# EasyEDA Pro project kuafu01_030内部老化方案_4.eprj, board PCB4 (continued)
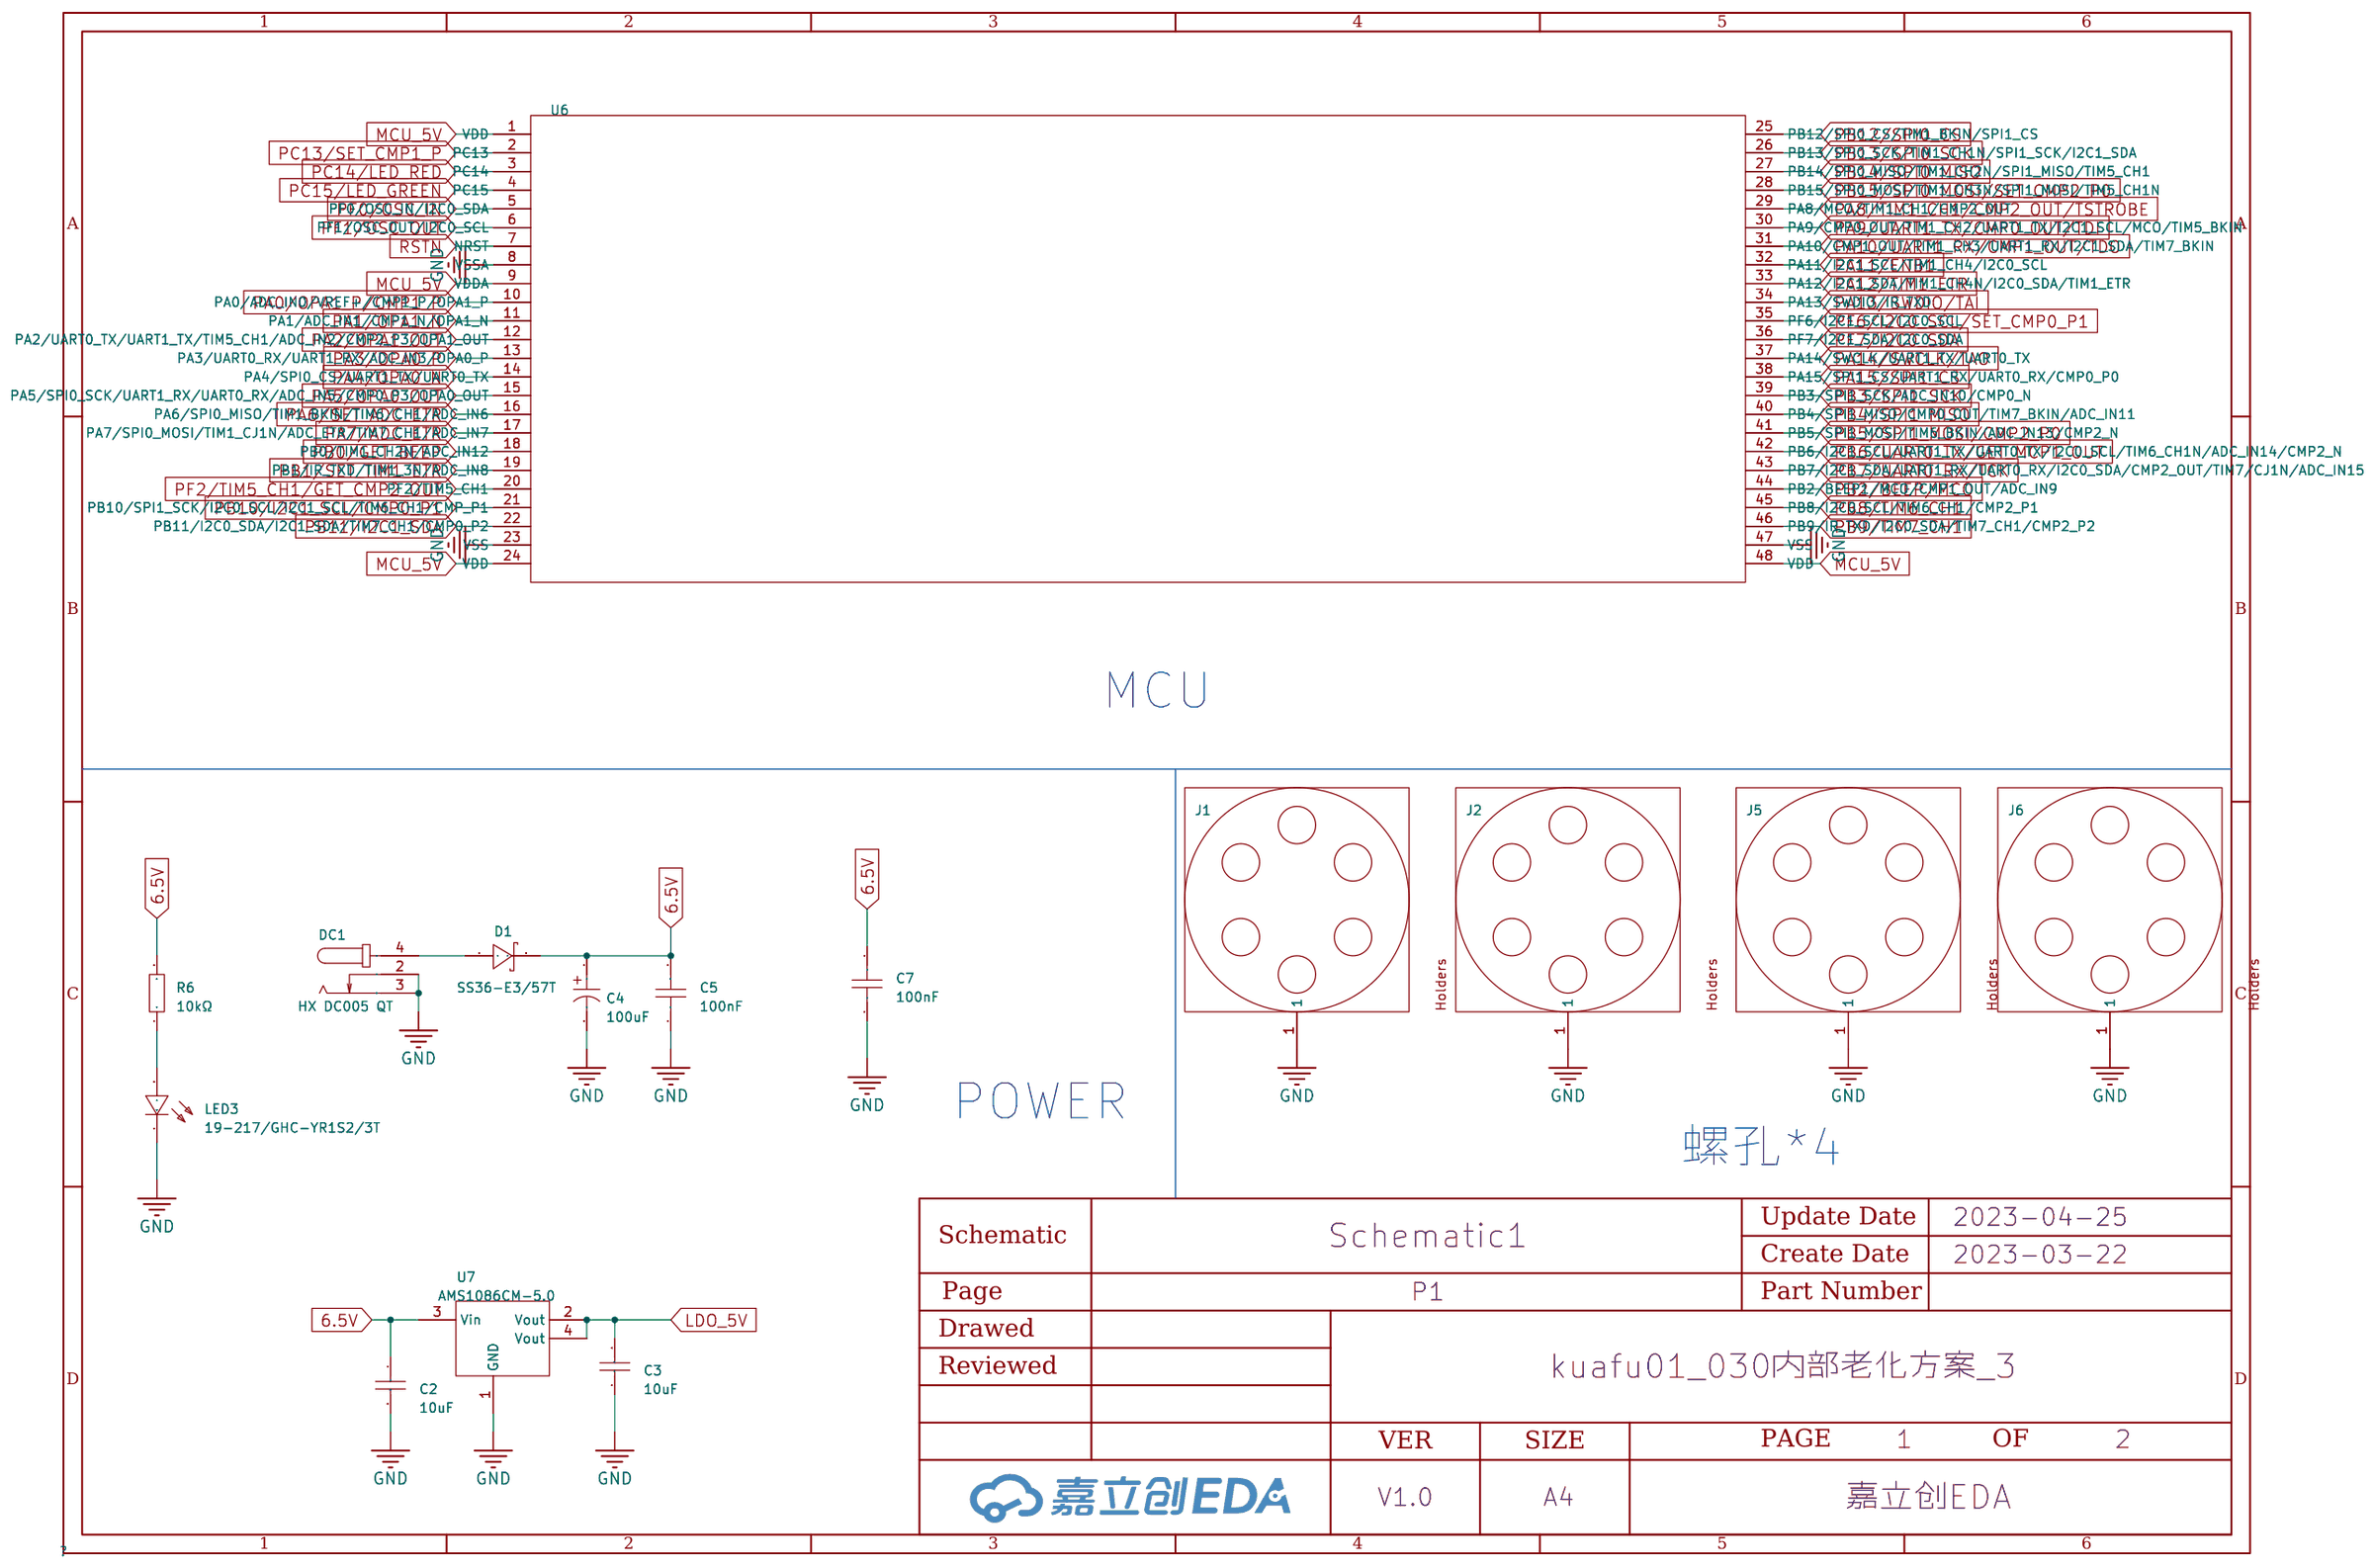
[diagram p0: P1]
## Routing (per net, layer and track width the routed paths; a pad name or vN(x,y) marks a point on that pad's centre or on a via; arc(x,y) is an arc through that point) (continued)
PB7/UART0_RX/TCK: length 1598.6
  Top Layer w0.28: U6#23.43 30.58,19.44 v1(31.47,20.33) 32.28,21.13 41.26,21.13 42.55,22.42 53.09,22.42 54.13,21.37 54.13,11.55 52.98,10.4 46.75,10.4 H4#22.2 ; U6#4.43 232.77,132.22 v1(233.66,133.11) 234.46,133.91 243.45,133.91 244.73,135.19 255.27,135.19 256.32,134.15 256.32,124.33 255.17,123.18 248.93,123.18 H4#5.2 ; U6#12.43 131.68,244.99 v1(132.56,245.88) 133.37,246.69 142.36,246.69 143.64,247.97 154.18,247.97 155.23,246.92 155.23,237.1 154.08,235.95 147.84,235.95 H4#10.2 ; U6#6.43 232.77,169.81 v1(233.66,170.7) 234.46,171.5 243.45,171.5 244.73,172.78 255.27,172.78 256.32,171.74 256.32,161.92 255.17,160.77 248.93,160.77 H4#7.2 ; U6#3.43 30.58,132.22 v1(31.47,133.11) 32.28,133.91 41.26,133.91 42.55,135.19 53.09,135.19 54.13,134.15 54.13,124.33 52.98,123.18 46.75,123.18 H4#3.2 ; U6#28.43 232.77,207.4 v1(233.66,208.29) 234.46,209.09 243.45,209.09 244.73,210.38 255.27,210.38 256.32,209.33 256.32,199.51 255.17,198.36 248.93,198.36 H4#27.2 ; 182.22,166.87 182.22,169.81 v1(183.11,170.7) 183.91,171.5 192.9,171.5 194.18,172.78 204.73,172.78 205.77,171.74 205.77,161.92 204.62,160.77 198.39,160.77 H4#11.2 ; H4#6.2 198.39,123.18 204.62,123.18 205.77,124.33 205.77,134.15 204.73,135.19 194.18,135.19 192.9,133.91 183.91,133.91 v1(183.11,133.11) 182.22,132.22 182.22,129.28 ; 81.13,91.69 81.13,94.62 v1(82.02,95.51) 82.82,96.32 91.81,96.32 93.09,97.6 103.63,97.6 104.68,96.56 104.68,86.74 103.53,85.59 97.29,85.59 H4#19.2 ; 81.13,242.06 81.13,244.99 v1(82.02,245.88) 82.82,246.69 91.81,246.69 93.09,247.97 103.63,247.97 104.68,246.92 104.68,237.1 103.53,235.95 97.29,235.95 H4#32.2 ; U6#13.43 131.68,57.03 v1(132.56,57.92) 133.37,58.73 142.36,58.73 143.64,60.01 154.18,60.01 155.23,58.96 155.23,49.14 154.08,47.99 147.84,47.99 H4#15.2 ; H4#14.2 46.75,47.99 52.98,47.99 54.13,49.14 54.13,58.96 53.09,60.01 42.55,60.01 41.26,58.73 32.28,58.73 v1(31.47,57.92) 30.58,57.03 U6#14.43 ; 182.22,91.69 182.22,94.62 v1(183.11,95.51) 183.91,96.32 192.9,96.32 194.18,97.6 204.73,97.6 205.77,96.56 205.77,86.74 204.62,85.59 198.39,85.59 H4#21.2 ; 81.13,54.1 81.13,57.03 v1(82.02,57.92) 82.82,58.73 91.81,58.73 93.09,60.01 103.63,60.01 104.68,58.96 104.68,49.14 103.53,47.99 97.29,47.99 H4#12.2 ; U6#17.43 232.77,94.62 v1(233.66,95.51) 234.46,96.32 243.45,96.32 244.73,97.6 255.27,97.6 256.32,96.56 256.32,86.74 255.17,85.59 248.93,85.59 H4#18.2 ; 81.13,166.87 81.13,169.81 v1(82.02,170.7) 82.82,171.5 91.81,171.5 93.09,172.78 103.63,172.78 104.68,171.74 104.68,161.92 103.53,160.77 97.29,160.77 H4#8.2 ; 182.22,242.06 182.22,244.99 v1(183.11,245.88) 183.91,246.69 192.9,246.69 194.18,247.97 204.73,247.97 205.77,246.92 205.77,237.1 204.62,235.95 198.39,235.95 H4#24.2 ; U6#27.43 30.58,244.99 v1(31.47,245.88) 32.28,246.69 41.26,246.69 42.55,247.97 53.09,247.97 54.13,246.92 54.13,237.1 52.98,235.95 46.75,235.95 H4#25.2 ; H4#28.2 46.75,198.36 52.98,198.36 54.13,199.51 54.13,209.33 53.09,210.38 42.55,210.38 41.26,209.09 32.28,209.09 v1(31.47,208.29) 30.58,207.4 U6#31.43 ; H4#2.2 46.75,160.77 52.98,160.77 54.13,161.92 54.13,171.74 53.09,172.78 42.55,172.78 41.26,171.5 32.28,171.5 v1(31.47,170.7) 30.58,169.81 U6#9.43 ; H4#9.2 147.84,160.77 154.08,160.77 155.23,161.92 155.23,171.74 154.18,172.78 143.64,172.78 142.36,171.5 133.37,171.5 v1(132.56,170.7) 131.68,169.81 U6#8.43 ; U6#26.43 232.77,244.99 v1(233.66,245.88) 234.46,246.69 243.45,246.69 244.73,247.97 255.27,247.97 256.32,246.92 256.32,237.1 255.17,235.95 248.93,235.95 H4#26.2 ; U6#2.43 131.68,132.22 v1(132.56,133.11) 133.37,133.91 142.36,133.91 143.64,135.19 154.18,135.19 155.23,134.15 155.23,124.33 154.08,123.18 147.84,123.18 H4#4.2 ; U6#15.43 232.77,57.03 v1(233.66,57.92) 234.46,58.73 243.45,58.73 244.73,60.01 255.27,60.01 256.32,58.96 256.32,49.14 255.17,47.99 248.93,47.99 H4#16.2 ; 81.13,129.28 81.13,132.22 v1(82.02,133.11) 82.82,133.91 91.81,133.91 93.09,135.19 103.63,135.19 104.68,134.15 104.68,124.33 103.53,123.18 97.29,123.18 H4.2 ; H4#31.2 198.39,198.36 204.62,198.36 205.77,199.51 205.77,209.33 204.73,210.38 194.18,210.38 192.9,209.09 183.91,209.09 v1(183.11,208.29) 182.22,207.4 182.22,204.47 ; H4#20.2 147.84,85.59 154.08,85.59 155.23,86.74 155.23,96.56 154.18,97.6 143.64,97.6 142.36,96.32 133.37,96.32 v1(132.56,95.51) 131.68,94.62 U6#19.43 ; U6#30.43 131.68,207.4 v1(132.56,208.29) 133.37,209.09 142.36,209.09 143.64,210.38 154.18,210.38 155.23,209.33 155.23,199.51 154.08,198.36 147.84,198.36 H4#30.2 ; H4#23.2 248.93,10.4 255.17,10.4 256.32,11.55 256.32,21.37 255.27,22.42 244.73,22.42 243.45,21.13 234.46,21.13 v1(233.66,20.33) 232.77,19.44 U6#24.43 ; U6#20.43 30.58,94.62 v1(31.47,95.51) 32.28,96.32 41.26,96.32 42.55,97.6 53.09,97.6 54.13,96.56 54.13,86.74 52.98,85.59 46.75,85.59 H4#13.2 ; 81.13,204.47 81.13,207.4 v1(82.02,208.29) 82.82,209.09 91.81,209.09 93.09,210.38 103.63,210.38 104.68,209.33 104.68,199.51 103.53,198.36 97.29,198.36 H4#29.2 ; 182.22,54.1 182.22,57.03 v1(183.11,57.92) 183.91,58.73 192.9,58.73 194.18,60.01 204.73,60.01 205.77,58.96 205.77,49.14 204.62,47.99 198.39,47.99 H4#17.2
  Bottom Layer w0.28: v1(31.47,208.29) 31.01,208.75 31.01,211.81 CN1#27.5 ; v1(183.11,57.92) 182.65,58.38 182.65,61.44 CN1#21.5 ; v1(31.47,57.92) 31.01,58.38 31.01,61.44 CN1#15.5 ; CN1#13.5 182.65,99.03 182.65,95.97 v1(183.11,95.51) ; v1(233.66,133.11) 233.2,133.56 233.2,136.63 CN1.5 ; CN1#26.5 233.2,249.4 233.2,246.34 v1(233.66,245.88) ; v1(82.02,208.29) 81.56,208.75 81.56,211.81 CN1#30.5 ; CN1#12.5 233.2,61.44 233.2,58.38 v1(233.66,57.92) ; v1(132.56,133.11) 132.11,133.56 132.11,136.63 CN1#8.5 ; v1(31.47,170.7) 31.01,171.15 31.01,174.22 CN1#3.5 ; CN1#9.5 81.56,174.22 81.56,171.15 v1(82.02,170.7) ; v1(31.47,95.51) 31.01,95.97 31.01,99.03 CN1#14.5 ; v1(183.11,208.29) 182.65,208.75 182.65,211.81 CN1#28.5 ; v1(183.11,133.11) 182.65,133.56 182.65,136.63 CN1#10.5 ; v1(31.47,133.11) 31.01,133.56 31.01,136.63 CN1#4.5 ; CN1#18.5 132.11,99.03 132.11,95.97 v1(132.56,95.51) ; CN1#31.5 132.11,211.81 132.11,208.75 v1(132.56,208.29) ; v1(233.66,95.51) 233.2,95.97 233.2,99.03 CN1#17.5 ; v1(132.56,170.7) 132.11,171.15 132.11,174.22 CN1#7.5 ; v1(233.66,170.7) 233.2,171.15 233.2,174.22 CN1#6.5 ; v1(82.02,245.88) 81.56,246.34 81.56,249.4 CN1#32.5 ; CN1#24.5 31.01,249.4 31.01,246.34 v1(31.47,245.88) ; CN1#29.5 233.2,211.81 233.2,208.75 v1(233.66,208.29) ; v1(183.11,170.7) 182.65,171.15 182.65,174.22 CN1#2.5 ; v1(82.02,57.92) 81.56,58.38 81.56,61.44 CN1#16.5 ; CN1#20.5 81.56,99.03 81.56,95.97 v1(82.02,95.51) ; CN1#25.5 182.65,249.4 182.65,246.34 v1(183.11,245.88) ; CN1#11.5 132.11,249.4 132.11,246.34 v1(132.56,245.88) ; v1(132.56,57.92) 132.11,58.38 132.11,61.44 CN1#19.5 ; v1(82.02,133.11) 81.56,133.56 81.56,136.63 CN1#5.5 ; v1(31.47,20.33) 31.01,20.79 31.01,23.85 CN1#22.5 ; CN1#23.5 233.2,23.85 233.2,20.79 v1(233.66,20.33)
PB8/TIM6_CH1: length 16
  Top Layer w0.28: U6#31.45 U6#31.46 ; U6#17.45 U6#17.46 ; U6#12.45 U6#12.46 ; 181.22,54.1 U6#18.46 ; 80.13,204.47 U6#29.46 ; 181.22,91.69 U6#21.46 ; U6#15.45 U6#15.46 ; 80.13,54.1 U6#16.46 ; U6#6.45 U6#6.46 ; U6#4.45 U6#4.46 ; U6#20.45 U6#20.46 ; U6#28.45 U6#28.46 ; U6#19.45 U6#19.46 ; U6#24.45 U6#24.46 ; 181.22,204.47 U6#32.46 ; 80.13,91.69 U6#22.46 ; U6#26.45 U6#26.46 ; 80.13,242.06 U6.46 ; U6#9.45 U6#9.46 ; U6#3.45 U6#3.46 ; 80.13,129.28 U6#5.46 ; 181.22,129.28 U6#7.46 ; U6#30.45 U6#30.46 ; U6#23.45 U6#23.46 ; 181.22,166.87 U6#10.46 ; U6#2.45 U6#2.46 ; U6#27.45 U6#27.46 ; 80.13,166.87 U6#11.46 ; 181.22,242.06 U6#25.46 ; U6#14.45 U6#14.46 ; U6#8.45 U6#8.46 ; U6#13.45 U6#13.46
PB10/I2C1_SCL/CMP0_P1: length 907.4
  Top Layer w0.28: U6#31.21 32.08,193.57 32.49,193.16 36.77,193.16 v1(37.36,193.75) ; v1(87.91,156.16) 87.32,155.57 83.04,155.57 82.63,155.98 U6#11.21 ; v1(189,43.38) 188.41,42.79 184.13,42.79 183.72,43.21 U6#18.21 ; 145.27,130.79 145.23,130.75 142.67,130.75 140.02,128.1 138.49,128.1 v1(138.47,128.13) 138.11,128.13 137.31,127.33 U6#2.35 ; v1(239.55,156.16) 238.96,155.57 234.68,155.57 234.27,155.98 U6#6.21 ; U6.35 86.76,240.11 87.56,240.9 v1(87.92,240.9) 87.95,240.88 89.47,240.88 92.12,243.52 94.69,243.52 94.73,243.56 ; U6#30.21 133.17,193.57 133.59,193.16 137.87,193.16 v1(138.46,193.75) ; U6#32.35 187.86,202.52 188.65,203.31 v1(189.01,203.31) 189.04,203.28 190.56,203.28 193.21,205.93 195.78,205.93 195.82,205.97 ; U6#13.35 137.31,52.15 138.11,52.94 v1(138.47,52.94) 138.49,52.92 140.02,52.92 142.67,55.56 145.23,55.56 145.27,55.6 ; 94.73,55.6 94.69,55.56 92.12,55.56 89.47,52.92 87.95,52.92 v1(87.92,52.94) 87.56,52.94 86.76,52.15 U6#16.35 ; U6#27.21 32.08,231.17 32.49,230.75 36.77,230.75 v1(37.36,231.34) ; U6#12.35 137.31,240.11 138.11,240.9 v1(138.47,240.9) 138.49,240.88 140.02,240.88 142.67,243.52 145.23,243.52 145.27,243.56 ; v1(138.46,118.57) 137.87,117.98 133.59,117.98 133.17,118.39 U6#2.21 ; U6#28.21 234.27,193.57 234.68,193.16 238.96,193.16 v1(239.55,193.75) ; U6#4.35 238.4,127.33 239.2,128.13 v1(239.56,128.13) 239.59,128.1 241.11,128.1 243.76,130.75 246.33,130.75 246.36,130.79 ; U6#23.35 36.22,14.56 37.01,15.35 v1(37.37,15.35) 37.4,15.32 38.93,15.32 41.58,17.97 44.14,17.97 44.18,18.01 ; U6#30.35 137.31,202.52 138.11,203.31 v1(138.47,203.31) 138.49,203.28 140.02,203.28 142.67,205.93 145.23,205.93 145.27,205.97 ; 44.18,243.56 44.14,243.52 41.58,243.52 38.93,240.88 37.4,240.88 v1(37.37,240.9) 37.01,240.9 36.22,240.11 U6#27.35 ; 195.82,243.56 195.78,243.52 193.21,243.52 190.56,240.88 189.04,240.88 v1(189.01,240.9) 188.65,240.9 187.86,240.11 U6#25.35 ; U6#19.35 137.31,89.74 138.11,90.54 v1(138.47,90.54) 138.49,90.51 140.02,90.51 142.67,93.16 145.23,93.16 145.27,93.2 ; v1(87.91,43.38) 87.32,42.79 83.04,42.79 82.63,43.21 U6#16.21 ; 44.18,205.97 44.14,205.93 41.58,205.93 38.93,203.28 37.4,203.28 v1(37.37,203.31) 37.01,203.31 36.22,202.52 U6#31.35 ; v1(138.46,80.98) 137.87,80.39 133.59,80.39 133.17,80.8 U6#19.21 ; U6#4.21 234.27,118.39 234.68,117.98 238.96,117.98 v1(239.55,118.57) ; U6#29.21 82.63,193.57 83.04,193.16 87.32,193.16 v1(87.91,193.75) ; U6#6.35 238.4,164.92 239.2,165.72 v1(239.56,165.72) 239.59,165.69 241.11,165.69 243.76,168.34 246.33,168.34 246.36,168.38 ; U6#17.35 238.4,89.74 239.2,90.54 v1(239.56,90.54) 239.59,90.51 241.11,90.51 243.76,93.16 246.33,93.16 246.36,93.2 ; 94.73,130.79 94.69,130.75 92.12,130.75 89.47,128.1 87.95,128.1 v1(87.92,128.13) 87.56,128.13 86.76,127.33 U6#5.35 ; v1(189,118.57) 188.41,117.98 184.13,117.98 183.72,118.39 U6#7.21 ; U6#14.21 32.08,43.21 32.49,42.79 36.77,42.79 v1(37.36,43.38) ; U6#13.21 133.17,43.21 133.59,42.79 137.87,42.79 v1(138.46,43.38) ; U6#21.21 183.72,80.8 184.13,80.39 188.41,80.39 v1(189,80.98) ; U6#26.35 238.4,240.11 239.2,240.9 v1(239.56,240.9) 239.59,240.88 241.11,240.88 243.76,243.52 246.33,243.52 246.36,243.56 ; U6#20.35 36.22,89.74 37.01,90.54 v1(37.37,90.54) 37.4,90.51 38.93,90.51 41.58,93.16 44.14,93.16 44.18,93.2 ; U6#3.35 36.22,127.33 37.01,128.13 v1(37.37,128.13) 37.4,128.1 38.93,128.1 41.58,130.75 44.14,130.75 44.18,130.79 ; U6#22.21 82.63,80.8 83.04,80.39 87.32,80.39 v1(87.91,80.98) ; v1(37.36,156.16) 36.77,155.57 32.49,155.57 32.08,155.98 U6#9.21 ; U6#10.21 183.72,155.98 184.13,155.57 188.41,155.57 v1(189,156.16) ; U6#18.35 187.86,52.15 188.65,52.94 v1(189.01,52.94) 189.04,52.92 190.56,52.92 193.21,55.56 195.78,55.56 195.82,55.6 ; 246.36,55.6 246.33,55.56 243.76,55.56 241.11,52.92 239.59,52.92 v1(239.56,52.94) 239.2,52.94 238.4,52.15 U6#15.35 ; U6#9.35 36.22,164.92 37.01,165.72 v1(37.37,165.72) 37.4,165.69 38.93,165.69 41.58,168.34 44.14,168.34 44.18,168.38 ; U6#23.21 32.08,5.61 32.49,5.2 36.77,5.2 v1(37.36,5.79) ; v1(138.46,231.34) 137.87,230.75 133.59,230.75 133.17,231.17 U6#12.21 ; v1(239.55,231.34) 238.96,230.75 234.68,230.75 234.27,231.17 U6#26.21 ; U6#20.21 32.08,80.8 32.49,80.39 36.77,80.39 v1(37.36,80.98) ; U6#29.35 86.76,202.52 87.56,203.31 v1(87.92,203.31) 87.95,203.28 89.47,203.28 92.12,205.93 94.69,205.93 94.73,205.97 ; 145.27,168.38 145.23,168.34 142.67,168.34 140.02,165.69 138.49,165.69 v1(138.47,165.72) 138.11,165.72 137.31,164.92 U6#8.35 ; 195.82,130.79 195.78,130.75 193.21,130.75 190.56,128.1 189.04,128.1 v1(189.01,128.13) 188.65,128.13 187.86,127.33 U6#7.35 ; U6#21.35 187.86,89.74 188.65,90.54 v1(189.01,90.54) 189.04,90.51 190.56,90.51 193.21,93.16 195.78,93.16 195.82,93.2 ; 246.36,18.01 246.33,17.97 243.76,17.97 241.11,15.32 239.59,15.32 v1(239.56,15.35) 239.2,15.35 238.4,14.56 U6#24.35 ; U6#24.21 234.27,5.61 234.68,5.2 238.96,5.2 v1(239.55,5.79) ; U6.21 82.63,231.17 83.04,230.75 87.32,230.75 v1(87.91,231.34) ; U6#22.35 86.76,89.74 87.56,90.54 v1(87.92,90.54) 87.95,90.51 89.47,90.51 92.12,93.16 94.69,93.16 94.73,93.2 ; U6#14.35 36.22,52.15 37.01,52.94 v1(37.37,52.94) 37.4,52.92 38.93,52.92 41.58,55.56 44.14,55.56 44.18,55.6 ; U6#3.21 32.08,118.39 32.49,117.98 36.77,117.98 v1(37.36,118.57) ; 246.36,205.97 246.33,205.93 243.76,205.93 241.11,203.28 239.59,203.28 v1(239.56,203.31) 239.2,203.31 238.4,202.52 U6#28.35 ; v1(138.46,156.16) 137.87,155.57 133.59,155.57 133.17,155.98 U6#8.21 ; v1(239.55,80.98) 238.96,80.39 234.68,80.39 234.27,80.8 U6#17.21 ; U6#32.21 183.72,193.57 184.13,193.16 188.41,193.16 v1(189,193.75) ; U6#25.21 183.72,231.17 184.13,230.75 188.41,230.75 v1(189,231.34) ; v1(239.55,43.38) 238.96,42.79 234.68,42.79 234.27,43.21 U6#15.21 ; U6#5.21 82.63,118.39 83.04,117.98 87.32,117.98 v1(87.91,118.57) ; 94.73,168.38 94.69,168.34 92.12,168.34 89.47,165.69 87.95,165.69 v1(87.92,165.72) 87.56,165.72 86.76,164.92 U6#11.35 ; 195.82,168.38 195.78,168.34 193.21,168.34 190.56,165.69 189.04,165.69 v1(189.01,165.72) 188.65,165.72 187.86,164.92 U6#10.35
  Bottom Layer w0.28: v1(37.37,165.72) 37.36,165.71 v1(37.36,156.16) ; v1(87.92,128.13) 87.91,128.12 v1(87.91,118.57) ; v1(138.47,240.9) 138.46,240.89 v1(138.46,231.34) ; v1(239.56,203.31) 239.55,203.3 v1(239.55,193.75) ; v1(239.55,5.79) 239.55,15.34 v1(239.56,15.35) ; v1(37.37,52.94) 37.36,52.93 v1(37.36,43.38) ; v1(37.36,118.57) 37.36,128.12 v1(37.37,128.13) ; v1(239.55,231.34) 239.55,240.89 v1(239.56,240.9) ; v1(189.01,52.94) 189,52.93 v1(189,43.38) ; v1(138.47,165.72) 138.46,165.71 v1(138.46,156.16) ; v1(37.36,231.34) 37.36,240.89 v1(37.37,240.9) ; v1(189.01,128.13) 189,128.12 v1(189,118.57) ; v1(37.37,203.31) 37.36,203.3 v1(37.36,193.75) ; v1(189,156.16) 189,165.71 v1(189.01,165.72) ; v1(239.55,156.16) 239.55,165.71 v1(239.56,165.72) ; v1(138.47,90.54) 138.46,90.53 v1(138.46,80.98) ; v1(138.46,118.57) 138.46,128.12 v1(138.47,128.13) ; v1(138.46,193.75) 138.46,203.3 v1(138.47,203.31) ; v1(239.56,90.54) 239.55,90.53 v1(239.55,80.98) ; v1(37.36,5.79) 37.36,15.34 v1(37.37,15.35) ; v1(87.92,90.54) 87.91,90.53 v1(87.91,80.98) ; v1(189,193.75) 189,203.3 v1(189.01,203.31) ; v1(87.92,165.72) 87.91,165.71 v1(87.91,156.16) ; v1(37.37,90.54) 37.36,90.53 v1(37.36,80.98) ; v1(239.56,52.94) 239.55,52.93 v1(239.55,43.38) ; v1(87.91,43.38) 87.91,52.93 v1(87.92,52.94) ; v1(189.01,240.9) 189,240.89 v1(189,231.34) ; v1(87.92,240.9) 87.91,240.89 v1(87.91,231.34) ; v1(189.01,90.54) 189,90.53 v1(189,80.98) ; v1(239.56,128.13) 239.55,128.12 v1(239.55,118.57) ; v1(87.91,193.75) 87.91,203.3 v1(87.92,203.31) ; v1(138.47,52.94) 138.46,52.93 v1(138.46,43.38)
PB11/I2C1_SDA: length 885.6
  Top Layer w0.28: v1(188.31,43.78) 187.82,43.29 184.51,43.29 184.22,43.59 184.22,45.7 ; v1(188.31,231.74) 187.82,231.25 184.51,231.25 184.22,231.55 184.22,233.66 ; 195.82,58.03 194.74,58.03 190.26,53.55 v1(188.31,53.55) 187.41,52.65 U6#18.36 ; U6#29.36 86.31,203.02 v1(87.22,203.92) 89.17,203.92 93.64,208.4 94.73,208.4 ; v1(87.22,118.97) 86.73,118.48 83.42,118.48 83.13,118.77 83.13,120.88 ; v1(87.22,43.78) 86.73,43.29 83.42,43.29 83.13,43.59 83.13,45.7 ; U6#31.36 35.77,203.02 v1(36.67,203.92) 38.62,203.92 43.1,208.4 44.18,208.4 ; 145.27,208.4 144.19,208.4 139.71,203.92 v1(137.77,203.92) 136.86,203.02 U6#30.36 ; U6#32.36 187.41,203.02 v1(188.31,203.92) 190.26,203.92 194.74,208.4 195.82,208.4 ; v1(137.77,194.15) 137.28,193.66 133.97,193.66 133.68,193.95 U6#30.22 ; U6#9.36 35.77,165.42 v1(36.67,166.33) 38.62,166.33 43.1,170.81 44.18,170.81 ; U6#3.22 32.58,118.77 32.87,118.48 36.18,118.48 v1(36.67,118.97) ; v1(36.67,6.19) 36.18,5.7 32.87,5.7 32.58,5.99 U6#23.22 ; U6#27.36 35.77,240.61 v1(36.67,241.51) 38.62,241.51 43.1,245.99 44.18,245.99 ; v1(238.86,6.19) 238.37,5.7 235.06,5.7 234.77,5.99 U6#24.22 ; U6#4.22 234.77,118.77 235.06,118.48 238.37,118.48 v1(238.86,118.97) ; U6#14.36 35.77,52.65 v1(36.67,53.55) 38.62,53.55 43.1,58.03 44.18,58.03 ; 94.73,95.62 93.64,95.62 89.17,91.15 v1(87.22,91.15) 86.31,90.24 U6#22.36 ; U6#5.36 86.31,127.83 v1(87.22,128.74) 89.17,128.74 93.64,133.21 94.73,133.21 ; 44.18,133.21 43.1,133.21 38.62,128.74 v1(36.67,128.74) 35.77,127.83 U6#3.36 ; U6#13.36 136.86,52.65 v1(137.77,53.55) 139.71,53.55 144.19,58.03 145.27,58.03 ; U6#17.22 234.77,81.18 235.06,80.89 238.37,80.89 v1(238.86,81.38) ; 195.82,170.81 194.74,170.81 190.26,166.33 v1(188.31,166.33) 187.41,165.42 U6#10.36 ; v1(188.31,81.38) 187.82,80.89 184.51,80.89 184.22,81.18 184.22,83.29 ; 184.22,120.88 184.22,118.77 184.51,118.48 187.82,118.48 v1(188.31,118.97) ; 145.27,245.99 144.19,245.99 139.71,241.51 v1(137.77,241.51) 136.86,240.61 U6#12.36 ; U6#25.36 187.41,240.61 v1(188.31,241.51) 190.26,241.51 194.74,245.99 195.82,245.99 ; U6#15.22 234.77,43.59 235.06,43.29 238.37,43.29 v1(238.86,43.78) ; U6#26.22 234.77,231.55 235.06,231.25 238.37,231.25 v1(238.86,231.74) ; 246.36,170.81 245.28,170.81 240.81,166.33 v1(238.86,166.33) 237.95,165.42 U6#6.36 ; U6#8.22 133.68,156.36 133.97,156.07 137.28,156.07 v1(137.77,156.56) ; v1(137.77,118.97) 137.28,118.48 133.97,118.48 133.68,118.77 U6#2.22 ; 94.73,245.99 93.64,245.99 89.17,241.51 v1(87.22,241.51) 86.31,240.61 U6.36 ; 145.27,133.21 144.19,133.21 139.71,128.74 v1(137.77,128.74) 136.86,127.83 U6#2.36 ; v1(36.67,43.78) 36.18,43.29 32.87,43.29 32.58,43.59 U6#14.22 ; U6#11.36 86.31,165.42 v1(87.22,166.33) 89.17,166.33 93.64,170.81 94.73,170.81 ; 83.13,83.29 83.13,81.18 83.42,80.89 86.73,80.89 v1(87.22,81.38) ; U6#12.22 133.68,231.55 133.97,231.25 137.28,231.25 v1(137.77,231.74) ; U6#16.36 86.31,52.65 v1(87.22,53.55) 89.17,53.55 93.64,58.03 94.73,58.03 ; 246.36,58.03 245.28,58.03 240.81,53.55 v1(238.86,53.55) 237.95,52.65 U6#15.36 ; v1(137.77,81.38) 137.28,80.89 133.97,80.89 133.68,81.18 U6#19.22 ; 195.82,95.62 194.74,95.62 190.26,91.15 v1(188.31,91.15) 187.41,90.24 U6#21.36 ; v1(87.22,194.15) 86.73,193.66 83.42,193.66 83.13,193.95 83.13,196.07 ; U6#8.36 136.86,165.42 v1(137.77,166.33) 139.71,166.33 144.19,170.81 145.27,170.81 ; U6#9.22 32.58,156.36 32.87,156.07 36.18,156.07 v1(36.67,156.56) ; U6#27.22 32.58,231.55 32.87,231.25 36.18,231.25 v1(36.67,231.74) ; 246.36,95.62 245.28,95.62 240.81,91.15 v1(238.86,91.15) 237.95,90.24 U6#17.36 ; v1(188.31,156.56) 187.82,156.07 184.51,156.07 184.22,156.36 184.22,158.47 ; v1(238.86,194.15) 238.37,193.66 235.06,193.66 234.77,193.95 U6#28.22 ; 44.18,95.62 43.1,95.62 38.62,91.15 v1(36.67,91.15) 35.77,90.24 U6#20.36 ; 184.22,196.07 184.22,193.95 184.51,193.66 187.82,193.66 v1(188.31,194.15) ; U6#20.22 32.58,81.18 32.87,80.89 36.18,80.89 v1(36.67,81.38) ; U6#24.36 237.95,15.06 v1(238.86,15.96) 240.81,15.96 245.28,20.44 246.36,20.44 ; U6#13.22 133.68,43.59 133.97,43.29 137.28,43.29 v1(137.77,43.78) ; U6#19.36 136.86,90.24 v1(137.77,91.15) 139.71,91.15 144.19,95.62 145.27,95.62 ; 83.13,233.66 83.13,231.55 83.42,231.25 86.73,231.25 v1(87.22,231.74) ; 44.18,20.44 43.1,20.44 38.62,15.96 v1(36.67,15.96) 35.77,15.06 U6#23.36 ; 246.36,133.21 245.28,133.21 240.81,128.74 v1(238.86,128.74) 237.95,127.83 U6#4.36 ; U6#31.22 32.58,193.95 32.87,193.66 36.18,193.66 v1(36.67,194.15) ; 246.36,208.4 245.28,208.4 240.81,203.92 v1(238.86,203.92) 237.95,203.02 U6#28.36 ; 83.13,158.47 83.13,156.36 83.42,156.07 86.73,156.07 v1(87.22,156.56) ; v1(238.86,156.56) 238.37,156.07 235.06,156.07 234.77,156.36 U6#6.22 ; 195.82,133.21 194.74,133.21 190.26,128.74 v1(188.31,128.74) 187.41,127.83 U6#7.36 ; U6#26.36 237.95,240.61 v1(238.86,241.51) 240.81,241.51 245.28,245.99 246.36,245.99
  Bottom Layer w0.28: v1(238.86,156.56) v1(238.86,166.33) ; v1(36.67,118.97) v1(36.67,128.74) ; v1(36.67,6.19) v1(36.67,15.96) ; v1(137.77,156.56) v1(137.77,166.33) ; v1(137.77,231.74) v1(137.77,241.51) ; v1(238.86,194.15) v1(238.86,203.92) ; v1(87.22,81.38) v1(87.22,91.15) ; v1(188.31,156.56) v1(188.31,166.33) ; v1(238.86,118.97) v1(238.86,128.74) ; v1(36.67,231.74) v1(36.67,241.51) ; v1(36.67,81.38) v1(36.67,91.15) ; v1(36.67,156.56) v1(36.67,166.33) ; v1(87.22,156.56) v1(87.22,166.33) ; v1(87.22,43.78) v1(87.22,53.55) ; v1(137.77,43.78) v1(137.77,53.55) ; v1(87.22,231.74) v1(87.22,241.51) ; v1(36.67,43.78) v1(36.67,53.55) ; v1(238.86,43.78) v1(238.86,53.55) ; v1(188.31,81.38) v1(188.31,91.15) ; v1(188.31,194.15) v1(188.31,203.92) ; v1(87.22,194.15) v1(87.22,203.92) ; v1(137.77,81.38) v1(137.77,91.15) ; v1(188.31,231.74) v1(188.31,241.51) ; v1(238.86,6.19) v1(238.86,15.96) ; v1(238.86,231.74) v1(238.86,241.51) ; v1(188.31,118.97) v1(188.31,128.74) ; v1(188.31,43.78) v1(188.31,53.55) ; v1(137.77,194.15) v1(137.77,203.92) ; v1(87.22,118.97) v1(87.22,128.74) ; v1(238.86,81.38) v1(238.86,91.15) ; v1(36.67,194.15) v1(36.67,203.92) ; v1(137.77,118.97) v1(137.77,128.74)
PB13/SPI0_SCK: length 724.6
  Top Layer w0.28: U6#5.26 86.43,122.83 86.81,122.45 90.05,122.45 v1(90.05,122.45) ; v1(39.5,18.95) 33.66,18.95 32.59,17.88 32.59,16.52 U6#23.39 ; v1(191.14,84.86) 191.14,84.86 187.9,84.86 187.52,85.24 U6#21.26 ; v1(241.69,94.14) 235.85,94.14 234.78,93.07 234.78,91.7 U6#17.39 ; v1(241.69,9.67) 241.69,9.67 238.45,9.67 238.06,10.06 U6#24.26 ; v1(90.05,160.04) 90.05,160.04 86.81,160.04 86.43,160.42 U6#11.26 ; U6#6.39 234.78,166.89 234.78,168.25 235.85,169.32 v1(241.69,169.32) ; 184.22,54.1 184.23,54.11 184.23,55.47 185.3,56.54 v1(191.14,56.54) ; U6#12.26 136.97,235.61 137.35,235.23 140.59,235.23 v1(140.6,235.22) ; v1(39.5,94.14) 33.66,94.14 32.59,93.07 32.59,91.7 U6#20.39 ; U6#26.26 238.06,235.61 238.45,235.23 241.69,235.23 v1(241.69,235.22) ; v1(140.6,84.86) 140.59,84.86 137.35,84.86 136.97,85.24 U6#19.26 ; v1(140.6,160.04) 140.59,160.04 137.35,160.04 136.97,160.42 U6#8.26 ; v1(191.14,169.32) 185.3,169.32 184.23,168.25 184.23,166.89 184.22,166.87 ; v1(191.14,131.73) 185.3,131.73 184.23,130.66 184.23,129.29 184.22,129.28 ; v1(241.69,244.5) 235.85,244.5 234.78,243.43 234.78,242.07 U6#26.39 ; v1(140.6,197.63) 140.59,197.63 137.35,197.63 136.97,198.02 U6#30.26 ; v1(191.14,160.04) 191.14,160.04 187.9,160.04 187.52,160.42 U6#10.26 ; v1(90.05,131.73) 84.21,131.73 83.14,130.66 83.14,129.29 83.13,129.28 ; U6#20.26 35.88,85.24 36.26,84.86 39.5,84.86 v1(39.5,84.86) ; v1(90.05,206.91) 84.21,206.91 83.14,205.84 83.14,204.48 83.13,204.47 ; 184.22,242.06 184.23,242.07 184.23,243.43 185.3,244.5 v1(191.14,244.5) ; U6#4.39 234.78,129.29 234.78,130.66 235.85,131.73 v1(241.69,131.73) ; v1(191.14,235.22) 191.14,235.23 187.9,235.23 187.52,235.61 U6#25.26 ; U6#18.26 187.52,47.65 187.9,47.27 191.14,47.27 v1(191.14,47.26) ; U6#32.26 187.52,198.02 187.9,197.63 191.14,197.63 v1(191.14,197.63) ; 83.13,242.06 83.14,242.07 83.14,243.43 84.21,244.5 v1(90.05,244.5) ; U6#6.26 238.06,160.42 238.45,160.04 241.69,160.04 v1(241.69,160.04) ; U6#3.26 35.88,122.83 36.26,122.45 39.5,122.45 v1(39.5,122.45) ; v1(140.6,169.32) 134.76,169.32 133.69,168.25 133.69,166.89 U6#8.39 ; v1(191.14,122.45) 191.14,122.45 187.9,122.45 187.52,122.83 U6#7.26 ; U6#12.39 133.69,242.07 133.69,243.43 134.76,244.5 v1(140.6,244.5) ; 83.13,166.87 83.14,166.89 83.14,168.25 84.21,169.32 v1(90.05,169.32) ; U6#24.39 234.78,16.52 234.78,17.88 235.85,18.95 v1(241.69,18.95) ; v1(241.69,84.86) 241.69,84.86 238.45,84.86 238.06,85.24 U6#17.26 ; U6#19.39 133.69,91.7 133.69,93.07 134.76,94.14 v1(140.6,94.14) ; v1(39.5,206.91) 33.66,206.91 32.59,205.84 32.59,204.48 U6#31.39 ; v1(90.05,94.14) 84.21,94.14 83.14,93.07 83.14,91.7 83.13,91.69 ; v1(191.14,206.91) 185.3,206.91 184.23,205.84 184.23,204.48 184.22,204.47 ; U6#13.26 136.97,47.65 137.35,47.27 140.59,47.27 v1(140.6,47.26) ; 83.13,54.1 83.14,54.11 83.14,55.47 84.21,56.54 v1(90.05,56.54) ; v1(241.69,122.45) 241.69,122.45 238.45,122.45 238.06,122.83 U6#4.26 ; v1(39.5,131.73) 33.66,131.73 32.59,130.66 32.59,129.29 U6#3.39 ; v1(39.5,235.22) 39.5,235.23 36.26,235.23 35.88,235.61 U6#27.26 ; U6#22.26 86.43,85.24 86.81,84.86 90.05,84.86 v1(90.05,84.86) ; U6#15.39 234.78,54.11 234.78,55.47 235.85,56.54 v1(241.69,56.54) ; v1(39.5,197.63) 39.5,197.63 36.26,197.63 35.88,198.02 U6#31.26 ; U6#14.26 35.88,47.65 36.26,47.27 39.5,47.27 v1(39.5,47.26) ; 184.22,91.69 184.23,91.7 184.23,93.07 185.3,94.14 v1(191.14,94.14) ; v1(90.05,235.22) 90.05,235.23 86.81,235.23 86.43,235.61 U6.26 ; v1(39.5,169.32) 33.66,169.32 32.59,168.25 32.59,166.89 U6#9.39 ; U6#30.39 133.69,204.48 133.69,205.84 134.76,206.91 v1(140.6,206.91) ; v1(241.69,47.26) 241.69,47.27 238.45,47.27 238.06,47.65 U6#15.26 ; U6#28.26 238.06,198.02 238.45,197.63 241.69,197.63 v1(241.69,197.63) ; U6#28.39 234.78,204.48 234.78,205.84 235.85,206.91 v1(241.69,206.91) ; U6#14.39 32.59,54.11 32.59,55.47 33.66,56.54 v1(39.5,56.54) ; v1(90.05,197.63) 90.05,197.63 86.81,197.63 86.43,198.02 U6#29.26 ; v1(140.6,131.73) 134.76,131.73 133.69,130.66 133.69,129.29 U6#2.39 ; U6#27.39 32.59,242.07 32.59,243.43 33.66,244.5 v1(39.5,244.5) ; U6#23.26 35.88,10.06 36.26,9.67 39.5,9.67 v1(39.5,9.67) ; U6#9.26 35.88,160.42 36.26,160.04 39.5,160.04 v1(39.5,160.04) ; U6#13.39 133.69,54.11 133.69,55.47 134.76,56.54 v1(140.6,56.54) ; v1(90.05,47.26) 90.05,47.27 86.81,47.27 86.43,47.65 U6#16.26 ; v1(140.6,122.45) 140.59,122.45 137.35,122.45 136.97,122.83 U6#2.26
  Bottom Layer w0.28: v1(140.6,122.45) v1(140.6,131.73) ; v1(241.69,197.63) v1(241.69,206.91) ; v1(90.05,122.45) v1(90.05,131.73) ; v1(39.5,47.26) v1(39.5,56.54) ; v1(90.05,235.22) v1(90.05,244.5) ; v1(140.6,235.22) v1(140.6,244.5) ; v1(140.6,160.04) v1(140.6,169.32) ; v1(241.69,47.26) v1(241.69,56.54) ; v1(191.14,122.45) v1(191.14,131.73) ; v1(140.6,197.63) v1(140.6,206.91) ; v1(241.69,9.67) v1(241.69,18.95) ; v1(140.6,84.86) v1(140.6,94.14) ; v1(90.05,197.63) v1(90.05,206.91) ; v1(90.05,160.04) v1(90.05,169.32) ; v1(241.69,160.04) v1(241.69,169.32) ; v1(90.05,84.86) v1(90.05,94.14) ; v1(241.69,84.86) v1(241.69,94.14) ; v1(39.5,160.04) v1(39.5,169.32) ; v1(39.5,9.67) v1(39.5,18.95) ; v1(90.05,47.26) v1(90.05,56.54) ; v1(140.6,47.26) v1(140.6,56.54) ; v1(39.5,235.22) v1(39.5,244.5) ; v1(241.69,122.45) v1(241.69,131.73) ; v1(39.5,122.45) v1(39.5,131.73) ; v1(191.14,160.04) v1(191.14,169.32) ; v1(191.14,197.63) v1(191.14,206.91) ; v1(39.5,84.86) v1(39.5,94.14) ; v1(191.14,47.26) v1(191.14,56.54) ; v1(241.69,235.22) v1(241.69,244.5) ; v1(191.14,235.22) v1(191.14,244.5) ; v1(39.5,197.63) v1(39.5,206.91) ; v1(191.14,84.86) v1(191.14,94.14)
